# EasyEDA Pro project 3SE_24_Power_Rune.eprj, board Armour (continued)
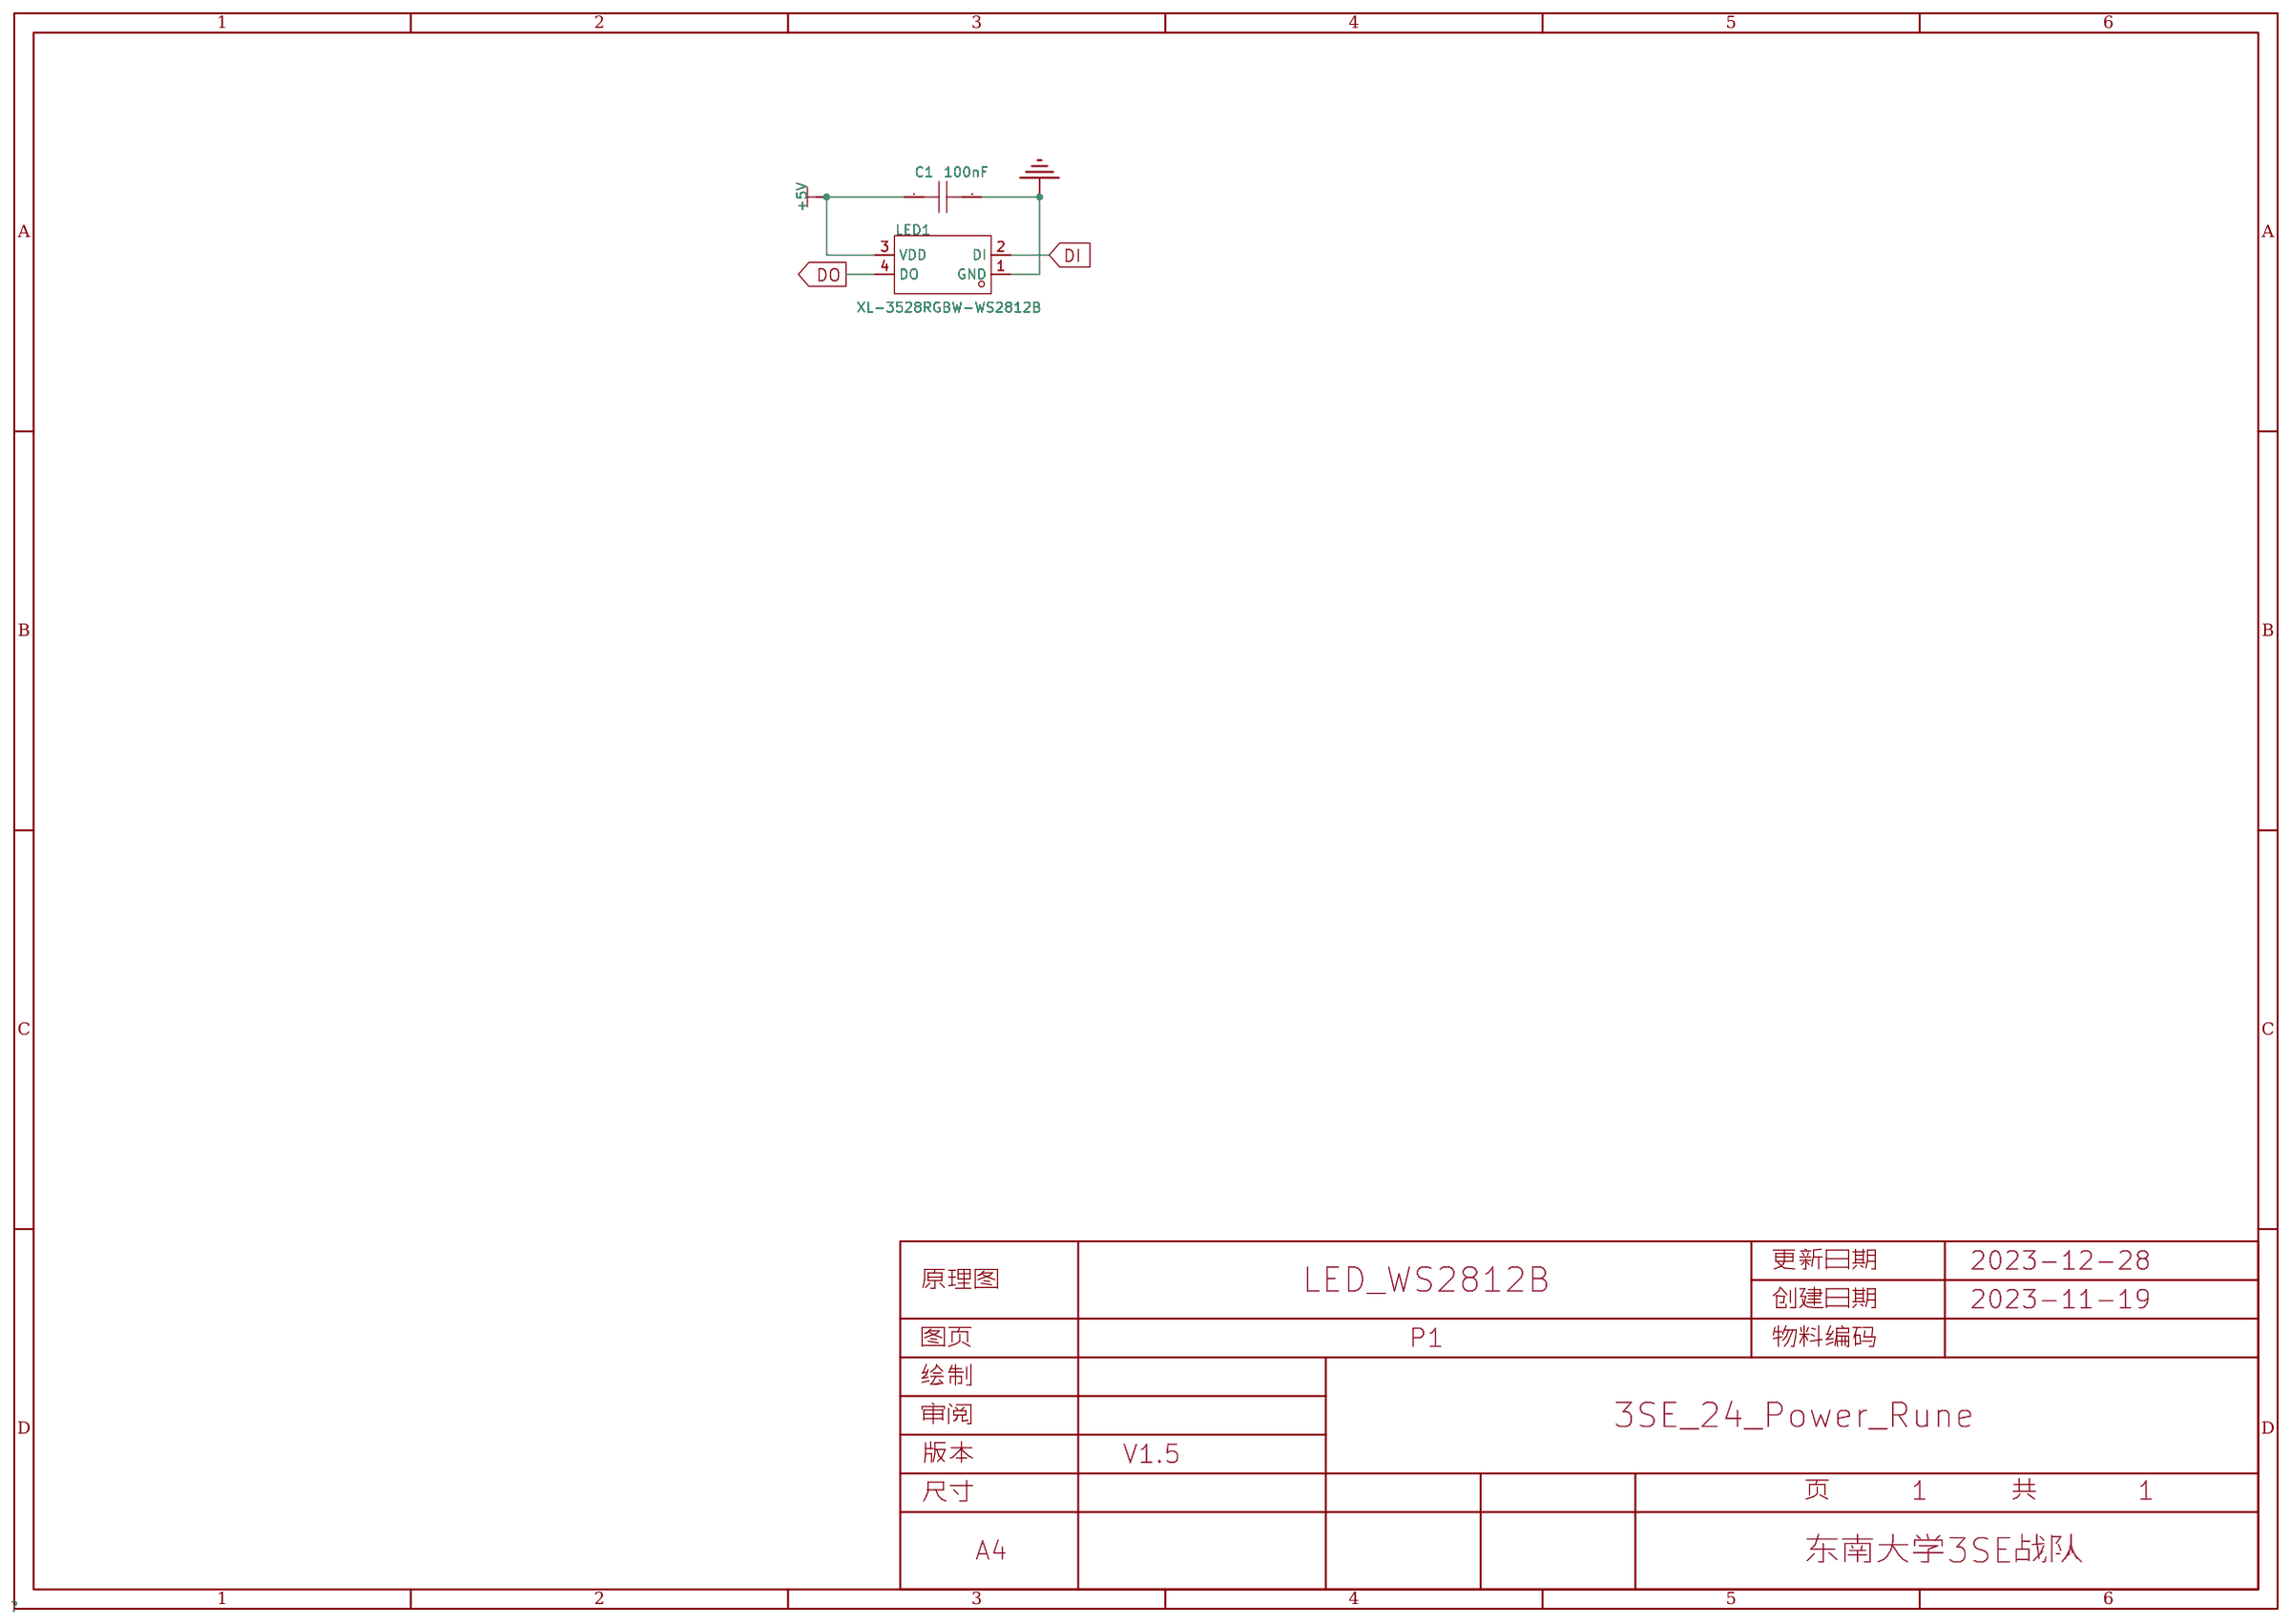
[diagram p0: schematic sheet]
## Routing (per net, layer and track width the routed paths; a pad name or vN(x,y) marks a point on that pad's centre or on a via; arc(x,y) is an arc through that point) (continued)
$12N306: length 22.6
  Top Layer w0.254: LED269.4 318.51,334.47 315.49,334.47 312.38,331.36 307.43,331.36 306.27,332.52 306.27,334.04 307.32,335.09 309.19,335.09
$12N308: length 25.5
  Top Layer w0.254: LED271.2 294.32,339.24 293.64,338.56 293.64,337.33 295.34,335.64 300.22,335.64 302.97,338.38 309.75,338.38 LED270.4
$12N310: length 25.5
  Top Layer w0.254: 299.13,339.79 296.38,342.53 289.6,342.53 286.85,339.79 281.96,339.79 280.27,341.48 280.27,342.71 280.94,343.39 282.45,343.39
$12N312: length 25.3
  Top Layer w0.254: 285.73,343.94 282.98,346.68 276.19,346.68 273.45,343.94 268.94,343.94 266.86,346.01 266.86,346.86 267.54,347.54 269.04,347.54
$12N314: length 25.5
  Top Layer w0.254: LED273.4 269.64,350.83 262.86,350.83 260.11,348.08 255.22,348.08 253.52,349.78 253.52,351.01 254.2,351.69 LED274.2
$12N316: length 25.5
  Top Layer w0.254: LED275.2 240.83,355.83 240.15,355.16 240.15,353.93 241.85,352.23 246.74,352.23 249.48,354.98 256.27,354.98 259.02,352.23
$12N318: length 25.5
  Top Layer w0.254: 245.64,356.38 242.9,359.12 236.11,359.12 233.37,356.38 228.48,356.38 226.78,358.08 226.78,359.31 227.46,359.98 LED276.2
$12N320: length 103.9
  Top Layer w0.254: LED277.2 313.25,338.23 309.23,342.25 299.37,342.25 295.9,345.72 286.98,345.72 281.81,350.89 272.14,350.89 266.86,356.17 250.29,356.17 245.94,360.53 232.27,360.53
$12N322: length 24.8
  Top Layer w0.254: LED277.4 326.82,342.22 321.68,342.22 320.1,340.64 312.65,340.64 311.17,342.12 311.17,343.82 311.99,344.64 LED278.2
$12N702: length 25.5
  Top Layer w0.254: LED279.4 299.35,352.08 292.56,352.08 289.81,349.34 284.93,349.34 283.23,351.03 283.23,352.26 283.91,352.94 LED280.2
$12N704: length 25.5
  Top Layer w0.254: 272.01,357.09 270.5,357.09 269.83,356.42 269.83,355.19 271.52,353.49 276.41,353.49 279.16,356.24 285.94,356.24 288.69,353.49
$12N706: length 25.5
  Top Layer w0.254: LED282.2 257.17,361.24 256.49,360.56 256.49,359.33 258.19,357.63 263.07,357.63 265.82,360.38 272.6,360.38 LED281.4
$12N708: length 25.5
  Top Layer w0.254: LED282.4 259.23,364.53 252.45,364.53 249.7,361.78 244.81,361.78 243.12,363.48 243.12,364.71 243.79,365.38 245.3,365.38
$12N710: length 25.5
  Top Layer w0.254: LED284.2 230.42,369.53 229.75,368.86 229.75,367.63 231.44,365.93 236.33,365.93 239.08,368.68 245.86,368.68 LED283.4
$12N712: length 105.9
  Top Layer w0.254: 235.11,370.09 248.77,370.09 253.12,365.74 269.69,365.74 274.97,360.46 284.64,360.46 289.81,355.29 298.73,355.29 302.2,351.82 312.06,351.82 316.09,347.79 329.79,347.79 331.15,349.16 LED285.2
$12N714: length 28.6
  Top Layer w0.254: LED286.2 313.96,354.2 313.09,353.32 313.09,352.32 315.51,349.9 319.76,349.9 323.1,353.24 330.94,353.24 LED285.4
$12N716: length 25.5
  Top Layer w0.254: LED287.2 300.24,358.34 299.56,357.67 299.56,356.44 301.26,354.74 306.15,354.74 308.9,357.49 315.68,357.49 LED286.4
$12N718: length 25.5
  Top Layer w0.254: LED288.2 286.87,362.49 286.19,361.81 286.19,360.58 287.89,358.89 292.78,358.89 295.52,361.63 302.31,361.63 305.06,358.89
$12N720: length 25.5
  Top Layer w0.254: 261.63,370.79 260.13,370.79 259.45,370.11 259.45,368.88 261.15,367.18 266.03,367.18 268.78,369.93 275.57,369.93 LED289.4
$12N722: length 25.5
  Top Layer w0.254: 248.26,374.94 246.76,374.94 246.08,374.26 246.08,373.03 247.78,371.33 252.66,371.33 255.41,374.08 262.2,374.08 LED290.4
$12N724: length 25.3
  Top Layer w0.254: LED291.4 249.09,377.96 241.78,377.96 239.29,375.48 234.41,375.48 232.71,377.18 232.71,378.41 233.38,379.08 234.89,379.08
$12N726: length 44.7
  Top Layer w0.254: LED293.2 218.22,359.72 218.22,357.67 218.93,356.96 222.84,356.96 226.07,360.19 226.07,376.19 231.91,382.03 235.79,382.03 LED292.4
$12N728: length 26.7
  Top Layer w0.254: LED294.2 203.9,360.88 203.35,360.32 203.35,358.6 204.28,357.67 208.39,357.67 214.69,363.97 220.79,363.97 LED293.4
$12N730: length 26.7
  Top Layer w0.254: 191.36,360.87 189.88,360.87 189.33,360.31 189.33,358.59 190.26,357.66 194.37,357.66 200.67,363.96 206.76,363.96 208.36,362.37
$12N732: length 26.7
  Top Layer w0.254: LED295.4 192.79,363.97 186.69,363.97 180.39,357.67 176.28,357.67 175.35,358.6 175.35,360.32 175.9,360.88 LED296.2
$12N734: length 26.7
  Top Layer w0.254: LED296.4 178.79,363.97 172.69,363.97 166.39,357.67 162.28,357.67 161.35,358.6 161.35,360.32 161.9,360.88 LED297.2
$12N736: length 26.7
  Top Layer w0.254: 149.36,360.87 147.88,360.87 147.33,360.31 147.33,358.59 148.26,357.66 152.37,357.66 158.67,363.96 164.76,363.96 166.36,362.37
$12N978: length 26.7
  Top Layer w0.254: LED300.2 203.9,370.88 203.35,370.32 203.35,368.6 204.28,367.67 208.39,367.67 214.69,373.97 220.79,373.97 LED299.4
$12N980: length 26.7
  Top Layer w0.254: 208.36,372.37 206.76,373.96 200.67,373.96 194.37,367.66 190.26,367.66 189.33,368.59 189.33,370.31 189.88,370.87 191.36,370.87
$12N982: length 26.7
  Top Layer w0.254: LED302.2 175.9,370.88 175.35,370.32 175.35,368.6 176.28,367.67 180.39,367.67 186.69,373.97 192.79,373.97 LED301.4
$12N984: length 26.7
  Top Layer w0.254: LED303.2 161.9,370.88 161.35,370.32 161.35,368.6 162.28,367.67 166.39,367.67 172.69,373.97 178.79,373.97 LED302.4
$12N986: length 26.7
  Top Layer w0.254: 166.36,372.37 164.76,373.96 158.67,373.96 152.37,367.66 148.26,367.66 147.33,368.59 147.33,370.31 147.88,370.87 149.36,370.87
$12N988: length 70.5
  Top Layer w0.254: LED304.4 154.28,372.38 157.98,376.07 214.58,376.07 LED305.2
$12N990: length 26.7
  Top Layer w0.254: 222.36,382.37 220.76,383.96 214.67,383.96 208.37,377.66 204.26,377.66 203.33,378.59 203.33,380.31 203.88,380.87 205.36,380.87
$12N992: length 26.7
  Top Layer w0.254: 191.33,380.86 189.86,380.86 189.3,380.3 189.3,378.58 190.23,377.65 194.34,377.65 200.64,383.95 206.74,383.95 208.33,382.36
$12N994: length 26.7
  Top Layer w0.254: 194.36,382.37 192.76,383.96 186.67,383.96 180.37,377.66 176.26,377.66 175.33,378.59 175.33,380.31 175.88,380.87 177.36,380.87
$12N996: length 26.7
  Top Layer w0.254: 166.33,382.36 164.74,383.95 158.64,383.95 152.34,377.65 148.23,377.65 147.3,378.58 147.3,380.3 147.86,380.86 149.33,380.86
$12N998: length 45.7
  Top Layer w0.254: LED311.2 136.93,356.49 136.93,355.81 138.02,354.72 141.88,354.72 144.28,357.12 144.28,381.39 146.71,383.82 150.94,383.82 LED310.4
$12N1000: length 29.5
  Top Layer w0.254: 125.1,354.2 122.94,352.04 122.94,350.92 123.86,350 128.62,350 133.66,355.04 133.66,358.37 136.4,361.11 140.18,361.11 140.9,360.38 LED311.4
$12N1002: length 29.5
  Top Layer w0.254: 127.59,356.5 127.48,356.5 126.76,357.23 122.98,357.23 120.24,354.49 120.24,351.16 115.2,346.12 110.44,346.12 109.52,347.04 109.52,348.16 111.68,350.32
$12N1004: length 28.6
  Top Layer w0.254: 98.24,346.41 96.08,344.25 96.08,343.14 97,342.22 100.24,342.22 106.8,348.77 106.8,350.59 109.53,353.32 113.31,353.32 114.04,352.6 114.14,352.6
$12N1006: length 29.5
  Top Layer w0.254: 84.79,342.5 82.63,340.35 82.63,339.23 83.56,338.31 88.31,338.31 93.35,343.35 93.35,346.68 96.09,349.42 99.87,349.42 100.6,348.69 100.7,348.69
$12N1008: length 29.5
  Top Layer w0.254: LED315.4 87.13,344.76 86.4,345.48 82.62,345.48 79.88,342.75 79.88,339.42 74.84,334.38 70.08,334.38 69.16,335.3 69.16,336.41 71.32,338.57
$12N1010: length 29.5
  Top Layer w0.254: 57.74,334.62 55.58,332.46 55.58,331.35 56.5,330.43 61.26,330.43 66.3,335.47 66.3,338.8 69.03,341.53 72.81,341.53 73.54,340.81 73.64,340.81
$12N1012: length 25.5
  Top Layer w0.254: LED317.4 60.24,336.94 59.51,337.67 55.54,337.67 53.84,335.96 53.84,329.33 51.01,326.5 47.67,326.5 46.72,327.45 46.72,328.63 47.8,329.71
$12N1254: length 29.5
  Top Layer w0.254: 122.45,363.84 120.29,361.69 120.29,360.57 121.21,359.65 125.97,359.65 131.01,364.69 131.01,368.02 133.75,370.76 137.53,370.76 138.26,370.03 138.36,370.03
$12N1256: length 29.5
  Top Layer w0.254: 124.94,366.15 124.84,366.15 124.11,366.87 120.33,366.87 117.6,364.14 117.6,360.81 112.56,355.77 107.8,355.77 106.88,356.69 106.88,357.8 109.03,359.96
$12N1258: length 29.5
  Top Layer w0.254: 111.5,362.24 111.39,362.24 110.67,362.97 106.89,362.97 104.15,360.23 104.15,356.9 99.11,351.86 94.35,351.86 93.43,352.78 93.43,353.9 95.59,356.06
$12N1260: length 29.5
  Top Layer w0.254: 98.05,358.33 97.95,358.33 97.22,359.06 93.44,359.06 90.71,356.32 90.71,352.99 85.67,347.95 80.91,347.95 79.99,348.87 79.99,349.99 82.15,352.15
$12N1262: length 29.5
  Top Layer w0.254: 68.68,348.22 66.52,346.06 66.52,344.94 67.44,344.02 72.2,344.02 77.24,349.06 77.24,352.39 79.97,355.13 83.75,355.13 84.48,354.4 84.58,354.4
$12N1264: length 29.5
  Top Layer w0.254: 70.99,350.45 70.89,350.45 70.17,351.18 66.39,351.18 63.65,348.44 63.65,345.11 58.61,340.07 53.85,340.07 52.93,340.99 52.93,342.11 55.09,344.27
$12N1266: length 32.2
  Top Layer w0.254: 57.55,346.55 57.45,346.55 56.72,347.27 52.93,347.27 46.04,340.38 46.04,335.54 43.99,333.49 38.81,333.49 37.72,334.58 37.72,335.25 39.31,336.85 39.51,336.85
$12N1268: length 108.6
  Top Layer w0.254: LED327.2 132.96,374.32 126.72,368.08 115.76,368.08 111.94,364.26 101.7,364.26 97.75,360.31 89.45,360.31 85.64,356.5 76.76,356.5 72.64,352.38 63.62,352.38 59.85,348.61 51.45,348.61 LED326.4
$12N1270: length 29.1
  Top Layer w0.254: 135.57,379.63 135.47,379.63 134.74,380.36 131.55,380.36 128.22,377.03 128.22,374.29 123.18,369.25 118.42,369.25 117.5,370.17 117.5,371.29 119.66,373.45
$12N1272: length 29.5
  Top Layer w0.254: 92.8,365.66 90.64,363.5 90.64,362.38 91.56,361.46 96.32,361.46 101.36,366.5 101.36,369.83 104.1,372.57 107.88,372.57 108.6,371.84 108.71,371.84
$12N1274: length 29.5
  Top Layer w0.254: 95.26,367.94 95.16,367.94 94.43,368.66 90.65,368.66 87.92,365.93 87.92,362.6 82.88,357.56 78.12,357.56 77.2,358.48 77.2,359.59 79.36,361.75
$12N1276: length 28.9
  Top Layer w0.254: 81.79,364 81.71,364.08 76.54,364.08 74.45,361.99 74.45,358.66 69.41,353.62 64.65,353.62 63.73,354.54 63.73,355.66 65.89,357.82
$12N1278: length 29.5
  Top Layer w0.254: LED332.4 68.1,360.06 67.38,360.78 63.6,360.78 60.86,358.05 60.86,354.72 55.82,349.68 51.06,349.68 50.14,350.6 50.14,351.71 LED333.2
$12N1280: length 35.8
  Top Layer w0.254: 35.2,348.95 33.58,348.95 32.85,348.22 32.85,345.96 33.9,344.91 38.69,344.91 44.02,350.24 44.02,355.91 44.98,356.88 53.93,356.88 54.66,356.15 LED333.4
$12N1282: length 56.8
  Top Layer w0.254: LED335.2 46.6,317.36 47.31,316.65 48.49,316.65 51.2,319.36 51.2,321.19 48.09,324.3 41.41,324.3 31.07,334.64 31.07,348.92 34.1,351.95 36.94,351.95 37.67,351.23
$12N1284: length 29.8
  Top Layer w0.254: LED335.4 45.44,321.44 42.78,318.78 42.78,313.53 48.75,307.56 48.75,301.37 47.1,299.72 45.1,299.72 LED336.2
$12N1286: length 24.9
  Top Layer w0.254: 41.23,288.78 41.23,288.42 41.88,287.76 44.81,287.76 45.36,288.31 45.36,292.9 40.3,297.96 40.3,302.9 41.5,304.1 43.02,304.1
$12N1288: length 29.6
  Top Layer w0.254: 38.51,274.03 LED338.2 38.44,271.66 39.15,270.95 40.03,270.95 42.64,273.56 42.64,278.15 37.58,283.21 37.58,289.28 40.3,292
$12N1638: length 62.8
  Top Layer w0.254: LED340.2 39.93,316.86 39.93,305.04 36.96,302.06 36.96,289.98 34.22,287.24 34.22,275.15 32.65,273.57 32.65,264.57 LED339.4
$12N1640: length 29.6
  Top Layer w0.254: 34.11,305.35 34.04,305.28 34.04,302.98 34.75,302.27 35.63,302.27 38.24,304.88 38.24,309.47 33.18,314.53 33.18,320.6 35.9,323.32
$12N1642: length 29.6
  Top Layer w0.254: 31.39,290.59 LED342.2 31.32,288.23 32.03,287.52 32.91,287.52 35.52,290.13 35.52,294.72 30.46,299.78 30.46,305.85 33.18,308.57
$12N1644: length 29.6
  Top Layer w0.254: 30.46,293.82 27.74,291.1 27.74,285.03 32.8,279.97 32.8,275.38 30.19,272.77 29.31,272.77 28.6,273.48 LED343.2 28.67,275.84
$12N1646: length 29.6
  Top Layer w0.254: 25.95,261.09 LED344.2 25.88,258.72 26.59,258.01 27.47,258.01 30.08,260.62 30.08,265.21 25.02,270.27 25.02,276.35 27.74,279.06
$12N1648: length 29.6
  Top Layer w0.254: 35.79,259.28 35.72,259.21 35.72,256.91 36.43,256.2 37.31,256.2 39.92,258.81 39.92,263.4 34.86,268.46 34.86,274.53 37.57,277.25
$12N1652: length 33.1
  Top Layer w0.254: 336.73,323.28 338.24,324.79 338.24,327.15 336.85,328.54 322.03,328.54 320.94,327.45 316.65,327.45 315.48,328.62 315.48,330.2 316.59,331.32 LED269.2
$12N1662: length 25.5
  Top Layer w0.254: LED279.2 297.28,348.79 296.6,348.12 296.6,346.89 298.3,345.19 303.19,345.19 305.93,347.94 312.72,347.94 LED278.4
$12N1671: length 25.5
  Top Layer w0.254: 274.97,366.64 273.47,366.64 272.79,365.97 272.79,364.74 274.49,363.04 279.37,363.04 282.12,365.79 288.9,365.79 291.65,363.04
$12N1676: length 70.5
  Top Layer w0.254: LED299.2 214.58,366.07 157.98,366.07 154.28,362.38 LED298.4
$12N1681: length 26.7
  Top Layer w0.254: 163.36,380.87 161.88,380.87 161.33,380.31 161.33,378.59 162.26,377.66 166.37,377.66 172.67,383.96 178.76,383.96 180.36,382.37
$12N1691: length 103.5
  Top Layer w0.254: LED318.4 50.26,334.53 54.74,339 62.64,339 66.41,342.77 75.43,342.77 79.55,346.89 88.43,346.89 92.24,350.7 100.54,350.7 104.49,354.65 114.73,354.65 118.55,358.47 129.51,358.47 135.75,364.72 LED319.2
$12N1696: length 29.5
  Top Layer w0.254: 106.24,369.57 104.09,367.41 104.09,366.29 105.01,365.37 109.77,365.37 114.8,370.41 114.8,373.74 117.54,376.48 121.32,376.48 122.05,375.75 122.15,375.75
$12N3097: length 29.4
  Top Layer w0.254: LED345.4 342.82,146.38 342.82,138.39 346.06,135.15 346.06,131.71 343.99,129.64 342.45,129.64 341.22,130.87 341.22,132.18 LED346.2
$12N3099: length 28.6
  Top Layer w0.254: 341.33,136.02 338.59,133.27 338.59,123.43 340.91,121.11 340.91,117.67 338.84,115.6 337.3,115.6 336.07,116.83 336.07,118.15 336.52,118.61
$12N3101: length 28.6
  Top Layer w0.254: 331.35,104.56 330.89,104.11 330.89,102.79 332.12,101.56 333.66,101.56 335.73,103.63 335.73,107.07 333.41,109.39 333.41,119.23 336.16,121.97
$12N3103: length 28.4
  Top Layer w0.254: 326.11,90.31 325.65,89.86 325.65,88.54 326.88,87.31 328.42,87.31 330.49,89.38 330.49,92.82 328.42,94.89 328.42,105.22 330.92,107.72
$12N3105: length 28.6
  Top Layer w0.254: 320.98,76.41 320.53,75.95 320.53,74.64 321.76,73.41 323.3,73.41 325.37,75.48 325.37,78.92 323.05,81.24 323.05,91.07 325.79,93.82
$12N3107: length 51.5
  Top Layer w0.254: 320.58,79.67 317.8,76.89 317.8,72.53 320.73,69.6 325.54,69.6 332.59,76.65 332.59,88.55 338.49,94.45 341.37,94.45 342.13,95.21 LED351.2
$12N3109: length 33
  Top Layer w0.254: LED351.4 341.8,98.72 342.56,99.48 346.72,99.48 347.59,98.62 347.59,83.7 342.19,78.3 341.35,78.3 LED352.2
$12N3111: length 25.9
  Top Layer w0.254: 338.84,83.8 335.72,80.68 335.72,65.84 334.4,64.52 332.98,64.52 332.21,65.29 332.21,66.5 331.44,67.27
$12N3113: length 25
  Top Layer w0.254: 331.11,70.6 328.78,68.27 328.78,66.45 334.28,60.95 342.84,60.95 344.23,62.34 LED354.2
$12N3115: length 26.9
  Top Layer w0.254: LED356.2 355.82,81.26 354.66,82.43 352.86,82.43 351.7,81.27 351.7,78.42 358.97,71.15 358.97,64.22 357.86,63.11
$12N3117: length 26.9
  Top Layer w0.254: 355.4,96.05 355.4,96.28 354.24,97.44 352.44,97.44 351.28,96.28 351.28,93.43 358.55,86.16 358.55,79.23 357.44,78.12
$12N3119: length 26.9
  Top Layer w0.254: 355,111.04 355,111.27 353.83,112.43 352.03,112.43 350.87,111.27 350.87,108.42 358.14,101.15 358.14,94.23 357.03,93.12
$12N3121: length 26.9
  Top Layer w0.254: LED358.4 357.75,109.19 357.75,116.12 350.48,123.39 350.48,126.24 351.64,127.4 353.44,127.4 354.61,126.24 LED359.2
$12N3123: length 27.9
  Top Layer w0.254: LED360.2 354.2,140.11 354.2,141.23 353.04,142.4 351.24,142.4 350.07,141.24 350.07,136.92 357.35,129.65 357.35,124.19 356.24,123.08
$12N3125: length 121.8
  Top Layer w0.254: LED361.2 336.06,37.22 335.13,36.29 335.13,34.77 335.88,34.02 339.75,34.02 341.22,35.49 341.22,40.02 360.58,59.38 360.58,132.41 355.86,137.13
$12N3127: length 44.1
  Top Layer w0.254: LED361.4 338.96,39.27 338.27,39.96 332.33,39.96 320.56,28.19 307.24,28.19 306,29.43 306,30.96 307.03,31.99 LED362.2
$12N3129: length 27
  Top Layer w0.254: LED362.4 311.43,34.66 305.25,34.66 301.61,31.02 301.61,29.2 298.59,26.18 294.08,26.18 293.27,26.99 293.27,28.42 293.91,29.05 LED363.2
$12N3131: length 27
  Top Layer w0.254: 279.99,26.14 279.22,26.14 278.58,25.5 278.58,24.07 279.39,23.26 283.9,23.26 286.93,26.28 286.93,28.1 290.56,31.74 296.74,31.74 297.35,31.13
$12N3133: length 27
  Top Layer w0.254: 267.93,25.27 267.32,25.88 261.14,25.88 257.5,22.24 257.5,20.42 254.48,17.4 249.97,17.4 249.16,18.21 249.16,19.64 249.8,20.28 250.57,20.28
$12N3135: length 27
  Top Layer w0.254: 253.22,22.33 252.61,22.94 246.43,22.94 242.79,19.31 242.79,17.49 239.77,14.47 235.26,14.47 234.45,15.28 234.45,16.71 235.09,17.34 235.86,17.34
$12N3137: length 27
  Top Layer w0.254: 238.51,19.4 237.9,20.01 231.72,20.01 228.08,16.37 228.08,14.55 225.06,11.53 220.55,11.53 219.74,12.34 219.74,13.77 220.38,14.41 221.15,14.41
$12N3139: length 116
  Top Layer w0.254: 325.17,45.57 325.17,41.24 321.74,37.82 303.17,37.82 299.64,34.29 286.88,34.29 284.08,31.49 271.28,31.49 268.26,28.47 257.01,28.47 254.18,25.64 242.6,25.64 239.35,22.39 229.71,22.39 LED368.4
$12N3141: length 29.2
  Top Layer w0.254: 327.87,47.62 327.76,47.62 327.07,48.31 321.05,48.31 311.56,38.82 306.92,38.82 306.22,39.52 306.22,40.98 307.04,41.79 LED370.2
$12N3143: length 27
  Top Layer w0.254: LED370.4 309.47,44.46 303.29,44.46 299.65,40.82 299.65,39 296.63,35.98 292.12,35.98 291.31,36.79 291.31,38.22 291.95,38.86 LED371.2
$12N3145: length 27
  Top Layer w0.254: 295.4,40.94 294.79,41.55 288.61,41.55 284.97,37.91 284.97,36.09 281.95,33.07 277.44,33.07 276.63,33.88 276.63,35.31 277.27,35.95 278.04,35.95
$12N3147: length 27
  Top Layer w0.254: 280.69,38.01 280.07,38.62 273.9,38.62 270.26,34.98 270.26,33.16 267.24,30.14 262.73,30.14 261.92,30.95 261.92,32.38 262.56,33.02 263.33,33.02
$12N3149: length 27
  Top Layer w0.254: 248.62,30.08 247.85,30.08 247.21,29.44 247.21,28.01 248.02,27.21 252.53,27.21 255.55,30.23 255.55,32.05 259.19,35.69 265.36,35.69 265.98,35.07
$12N3151: length 27
  Top Layer w0.254: 236.55,29.21 235.94,29.82 229.77,29.82 226.13,26.18 226.13,24.36 223.11,21.34 218.6,21.34 217.79,22.15 217.79,23.58 218.43,24.22 219.19,24.22
$12N3153: length 109.9
  Top Layer w0.254: 221.84,26.28 227.78,32.21 237.42,32.21 240.67,35.46 252.25,35.46 255.08,38.29 266.33,38.29 269.35,41.31 282.15,41.31 284.95,44.11 297.71,44.11 300.58,46.99 314.46,46.99 316.76,49.29 316.76,54.44 LED377.2
$12N3155: length 25.3
  Top Layer w0.254: LED377.4 319.52,56.71 318.83,57.4 314.92,57.4 314.19,56.67 314.19,51.3 311.44,48.55 305.22,48.55 304.45,49.32 304.45,50.57 LED378.2
$12N3157: length 27
  Top Layer w0.254: 290.79,48.69 290.02,48.69 289.38,48.05 289.38,46.62 290.19,45.81 294.7,45.81 297.73,48.83 297.73,50.65 301.37,54.29 307.54,54.29 308.15,53.68
$12N3159: length 27
  Top Layer w0.254: 293.47,50.77 292.86,51.38 286.68,51.38 283.04,47.74 283.04,45.92 280.02,42.9 275.51,42.9 274.7,43.71 274.7,45.14 275.34,45.78 276.11,45.78
$12N3161: length 9.9
  Top Layer w0.254: LED381.2 272.31,48.45 278.15,48.45 278.76,47.84
$12N3163: length 28.4
  Top Layer w0.254: 246.69,39.91 245.92,39.91 245.28,39.27 245.28,37.84 246.09,37.03 251.07,37.03 256.53,42.5 265.76,42.5 LED381.4
$12N3165: length 27
  Top Layer w0.254: 249.34,41.97 248.73,42.58 242.55,42.58 238.91,38.94 238.91,37.12 235.89,34.1 231.38,34.1 230.57,34.91 230.57,36.34 231.21,36.98 231.98,36.98
$12N3167: length 27
  Top Layer w0.254: 234.63,39.04 234.01,39.65 227.84,39.65 224.2,36.01 224.2,34.19 221.18,31.17 216.67,31.17 215.86,31.98 215.86,33.41 216.5,34.05 217.27,34.05
$12N3169: length 24.4
  Top Layer w0.254: LED386.2 190.81,12.35 190.81,10.88 191.78,9.91 198.27,9.91 200.25,11.89 200.25,14.9 201.35,16 206.04,16 LED385.4
$12N3171: length 29.3
  Top Layer w0.254: LED387.2 175.81,12.35 175.81,10.88 177.64,9.05 184.4,9.05 185.86,10.51 185.86,15.05 187.61,16.8 192.83,16.8 LED386.4
$12N3173: length 24.6
  Top Layer w0.254: LED388.2 163.23,12.35 163.23,10.88 164.2,9.91 168.25,9.91 170.24,11.89 170.24,14.89 171.35,16 178.63,16 LED387.4
$12N3175: length 42.4
  Top Layer w0.254: LED389.2 204.2,22.54 200.09,18.43 168.44,18.43 167.21,17.2 LED388.4
$12N3177: length 24.4
  Top Layer w0.254: LED389.4 206.04,26 201.35,26 200.25,24.9 200.25,21.89 198.27,19.91 191.78,19.91 190.81,20.88 190.81,22.35 LED390.2
$12N3179: length 27
  Top Layer w0.254: LED390.4 193.63,26 186.35,26 185.25,24.9 185.25,21.89 183.27,19.91 176.78,19.91 175.81,20.88 175.81,22.35 LED391.2
$12N3181: length 24.6
  Top Layer w0.254: LED391.4 178.63,26 171.35,26 170.25,24.9 170.25,21.91 168.25,19.91 164.2,19.91 163.23,20.88 163.23,22.35 LED392.2
$12N3183: length 41
  Top Layer w0.254: 167.14,24.83 169.55,27.24 198.89,27.24 204.2,32.55 LED393.2
$12N3185: length 24.4
  Top Layer w0.254: 207.23,34.84 206.06,36.01 201.37,36.01 200.27,34.91 200.27,31.9 198.29,29.92 191.8,29.92 190.83,30.89 190.83,32.36 191.82,33.34
$12N3187: length 24.5
  Top Layer w0.254: 168.21,29.92 164.22,29.92 163.25,30.89 163.25,32.36 164.24,33.34 ; 170.27,31.98 170.27,34.91 171.37,36.01 178.65,36.01 179.82,34.84 ; 170.27,31.98 170.28,31.99 ; 170.27,31.98 168.21,29.92
$12N3189: length 60.2
  Top Layer w0.254: 145.06,15.5 143.78,15.5 142.77,14.5 142.77,13.02 144.4,11.39 154.4,11.39 156.29,13.28 156.29,38.73 158.76,41.2 162.5,41.2 167.21,36.48 LED396.4
$12N3191: length 26.9
  Top Layer w0.254: 148.31,16.35 145.88,18.78 140.74,18.78 140.03,18.07 140.03,16.41 138.17,14.55 130.49,14.55 129.15,15.89 129.15,17.77 130,18.62 LED398.2
$12N3193: length 26.9
  Top Layer w0.254: LED399.2 115.33,21.73 114.48,20.88 114.48,19 115.82,17.66 123.5,17.66 125.36,19.52 125.36,21.18 126.07,21.89 131.21,21.89 LED398.4
$12N3195: length 26.9
  Top Layer w0.254: 101.05,24.85 100.66,24.85 99.8,24 99.8,22.12 101.14,20.78 108.82,20.78 110.68,22.64 110.68,24.3 111.39,25.01 116.54,25.01 LED399.4
$12N3197: length 26.9
  Top Layer w0.254: LED400.4 101.86,28.12 96.72,28.12 96.01,27.41 96.01,25.75 94.15,23.89 86.47,23.89 85.13,25.23 85.13,27.11 85.98,27.97 LED401.2
$12N3199: length 26.9
  Top Layer w0.254: LED401.4 87.19,31.24 82.05,31.24 81.34,30.53 81.34,28.87 79.48,27.01 71.8,27.01 70.46,28.35 70.46,30.23 71.31,31.08 71.7,31.08
$12N3201: length 26.9
  Top Layer w0.254: 75.04,31.89 72.61,34.32 67.47,34.32 66.76,33.61 66.76,31.95 64.9,30.09 57.22,30.09 55.88,31.43 55.88,33.31 56.73,34.16 57.12,34.16
$12N3203: length 35
  Top Layer w0.254: LED403.4 58.67,36.65 31.17,36.65 29.89,37.93 29.89,39.14 30.89,40.14 31.69,40.14 31.71,40.15
$12N3205: length 26.9
  Top Layer w0.254: LED406.2 132.08,28.4 131.23,27.55 131.23,25.67 132.57,24.33 140.25,24.33 142.11,26.19 142.11,27.85 142.82,28.56 147.96,28.56 LED405.4
$12N3207: length 26.9
  Top Layer w0.254: LED406.4 133.29,31.67 128.14,31.67 127.43,30.96 127.43,29.3 125.57,27.44 117.89,27.44 116.55,28.78 116.55,30.66 117.41,31.52 117.8,31.52
$12N3209: length 26.9
  Top Layer w0.254: LED408.2 102.73,34.63 101.88,33.78 101.88,31.9 103.22,30.56 110.9,30.56 112.76,32.42 112.76,34.08 113.47,34.79 118.61,34.79 LED407.4
$12N3211: length 26.9
  Top Layer w0.254: 106.37,35.48 103.94,37.9 98.8,37.9 98.09,37.19 98.09,35.53 96.23,33.67 88.55,33.67 87.21,35.01 87.21,36.89 88.06,37.75 LED409.2
$12N3213: length 25.9
  Top Layer w0.254: LED410.2 73.39,40.86 72.54,40.01 72.54,38.13 73.88,36.79 81.19,36.79 85.42,41.02 88.89,41.02 91.32,38.59 91.7,38.59
$12N3215: length 26.9
  Top Layer w0.254: 77.12,41.67 74.69,44.1 69.55,44.1 68.84,43.39 68.84,41.73 66.98,39.87 59.3,39.87 57.96,41.21 57.96,43.09 58.81,43.95 59.2,43.95
$12N3217: length 29.8
  Top Layer w0.254: LED412.2 40,48.25 39.11,48.25 38.5,47.64 38.5,45.69 39.44,44.75 44.23,44.75 46.08,46.6 60.58,46.6 62.35,44.82
$12N3219: length 115.5
  Top Layer w0.254: LED412.4 45.48,50.78 55.48,50.78 58.35,47.92 71.48,47.92 74.33,45.07 86.41,45.07 90.1,41.37 101.66,41.37 105.68,37.36 115.79,37.36 117.25,35.9 130.9,35.9 134.7,32.1 146.25,32.1 LED413.2
$12N3221: length 26.9
  Top Layer w0.254: LED413.4 150.04,38.34 144.89,38.34 144.18,37.63 144.18,35.97 142.32,34.11 134.64,34.11 133.3,35.45 133.3,37.33 134.16,38.18 LED414.2
$12N3223: length 30.6
  Top Layer w0.254: LED415.4 120.69,44.57 115.55,44.57 114.84,43.86 114.84,42.36 113.52,41.04 103.51,41.04 101.61,42.94 100.14,42.94 99.7,43.38 99.7,44.53 100.84,45.66 100.84,45.75
$12N3227: length 26.9
  Top Layer w0.254: LED418.2 75.47,50.65 74.61,49.79 74.61,47.91 75.95,46.57 83.63,46.57 85.49,48.43 85.49,50.09 86.2,50.8 91.35,50.8 93.77,48.37
$12N3229: length 26.9
  Top Layer w0.254: 79.19,51.46 76.77,53.88 71.62,53.88 70.91,53.17 70.91,51.51 69.05,49.65 61.37,49.65 60.03,50.99 60.03,52.87 60.89,53.73 61.28,53.73
$12N3231: length 26.9
  Top Layer w0.254: LED419.4 62.11,56.93 55.63,56.93 52.13,53.43 45.6,53.43 44.43,54.6 44.43,56.27 45.04,56.88 LED420.2
$12N3233: length 53.2
  Top Layer w0.254: LED421.2 13.97,69.37 12.7,69.37 11.67,68.34 11.67,62.57 13.85,60.39 29.57,60.39 33.18,64 43.48,64 LED420.4
$12N3235: length 25.3
  Top Layer w0.254: LED422.2 14.89,84.12 13.29,84.12 12.43,83.26 12.43,77.29 18.16,71.56 18.16,66.79 LED421.4
$12N3237: length 25.3
  Top Layer w0.254: 16.52,98.14 15.58,99.07 13.98,99.07 13.12,98.21 13.12,92.24 18.85,86.51 18.85,81.75 17.2,80.09
$12N3239: length 25.3
  Top Layer w0.254: 17.2,113.12 16.27,114.06 14.67,114.06 13.81,113.2 13.81,107.23 19.54,101.5 19.54,96.73 17.88,95.07
$12N3241: length 25.3
  Top Layer w0.254: 19.25,125.04 20.91,126.7 20.91,131.47 15.18,137.2 15.18,143.17 16.04,144.03 17.64,144.03 18.57,143.09
$12N3243: length 75.9
  Top Layer w0.254: LED426.4 23.48,136.5 23.48,69.98 LED427.2
$12N3245: length 12.7
  Top Layer w0.254: LED428.2 35.47,68.85 30.45,63.83 27.86,63.83
$12N3247: length 32.5
  Top Layer w0.254: 40.78,66.42 42.54,68.18 42.54,74.37 39.22,77.69 28.5,77.69 26.35,79.84 26.35,81.46 27.71,82.82 LED429.2
$12N3249: length 21
  Top Layer w0.254: LED430.2 26.84,95.7 26.04,94.9 26.04,92.05 32.76,85.33 32.76,81.29 LED429.4
$12N3253: length 16.2
  Top Layer w0.254: LED355.2 352.63,69.64 345.45,69.64 LED354.4
$12N3257: length 27
  Top Layer w0.254: 282.64,28.2 282.03,28.81 275.85,28.81 272.21,25.17 272.21,23.35 269.19,20.33 264.68,20.33 263.87,21.14 263.87,22.57 264.51,23.21 265.28,23.21
$12N3261: length 27
  Top Layer w0.254: 251.26,32.14 250.65,32.75 244.48,32.75 240.84,29.11 240.84,27.29 237.82,24.27 233.31,24.27 232.5,25.08 232.5,26.51 233.14,27.15 233.91,27.15
$12N3265: length 45.6
  Top Layer w0.254: LED384.4 219.75,36.06 219.06,36.75 216.17,36.75 213.48,34.06 213.48,12.1 211.34,9.96 203.54,9.96 202.28,11.22 202.28,12.01 203.6,13.33 LED385.2
$12N3269: length 30.6
  Top Layer w0.254: 194.82,34.84 190.98,38.68 184.9,38.68 182.56,36.34 182.56,30.9 181.58,29.92 176.8,29.92 175.83,30.89 175.83,32.36 176.82,33.34
$12N3273: length 121.2
  Top Layer w0.254: LED404.4 53.41,41 56.27,38.14 70.42,38.14 73.27,35.29 83.45,35.29 86.28,32.46 97.53,32.46 100.44,29.55 111.74,29.55 114.96,26.33 128.37,26.33 132.38,22.32 144.17,22.32 LED405.2
$12N3277: length 26.9
  Top Layer w0.254: 119.87,41.3 119.48,41.3 118.63,40.45 118.63,38.56 119.97,37.23 127.65,37.23 129.51,39.09 129.51,40.75 130.22,41.46 135.36,41.46 LED414.4
$12N3291: length 25.3
  Top Layer w0.254: 18.57,110.06 20.22,111.72 20.22,116.48 14.49,122.21 14.49,128.18 15.35,129.04 16.95,129.04 17.89,128.11
$12N3294: length 23.3
  Top Layer w0.254: 104.08,46.6 104.08,46.84 101.87,49.06 99.98,49.06 98.59,47.66 98.59,46 96.05,43.46 90.63,43.46 89.29,44.8 89.29,46.68 90.14,47.53 LED417.2
$12N6150: length 26.5
  Top Layer w0.254: 44.64,93.18 42.51,93.18 41.49,92.16 41.49,90.42 43.38,88.53 46.49,88.53 53.42,81.6 53.42,78.16 LED432.4
$12N6151: length 26.5
  Top Layer w0.254: LED433.4 48.56,92.35 48.56,95.79 41.63,102.72 38.52,102.72 36.63,104.61 36.63,106.35 37.65,107.37 LED434.2
$12N6152: length 24
  Top Layer w0.254: LED432.2 45.7,78.98 LED430.4
$12N6190: length 26.5
  Top Layer w0.254: 30.1,135.72 27.97,135.72 26.95,134.7 26.95,132.96 28.84,131.07 31.95,131.07 38.88,124.14 38.88,120.71 37.34,119.18
$12N6191: length 26.5
  Top Layer w0.254: 25.24,149.92 23.11,149.92 22.09,148.9 22.09,147.16 23.82,145.43 26.93,145.43 34.02,138.34 34.02,134.9 32.49,133.37
$12N6192: length 25.5
  Top Layer w0.254: 34.88,121.7 32.75,121.7 31.73,120.68 31.73,118.94 33.62,117.05 36.73,117.05 42.49,111.29 42.49,105.52 42.13,105.16

## Copper pours and planes (outline as drawn; the poured copper is in the pictures)
+3V3 on Top Layer: 329.98,211.35 338.95,211.35 338.95,203.31 329.98,203.31
+3V3 on Bottom Layer: 326.67,234.76 343.48,234.76 343.48,193.67 326.67,193.67
+5V on Top Layer: 329.09,204.59 333.27,204.59 333.27,201.24 329.09,201.24
+5V on Top Layer: 18.8,196.56 39.48,196.56 39.48,171.19 18.8,171.19
+5V on Bottom Layer: 145.24,353.42 114.06,343.81 61.2,329.25 39.24,249.17 25.16,249.33 18.55,259.49 31.63,356.77 135.27,386.99 235.21,386.61 287.79,370.99 339.23,355.12 343.8,319.05 348.37,291.87 352.94,257.33 343.67,248.06 330.56,248.06 310.4,327.68 268.11,340.51 226.25,353.42
+5V on Bottom Layer: 341.42,211.53 347.94,211.53 347.94,205.05 341.42,205.05
+5V on Bottom Layer: outline of 400 points within 25.75,36.24 345.74,356.23
+5V on Bottom Layer: 348.34,253.75 349.61,252.48 349.61,250.49 346.1,250.49 345.33,251.26 345.33,253.21 345.86,253.75
+5V on Bottom Layer: 167.66,45.36 67.83,63.21 32.19,157.82 11.44,152.77 10.42,135.25 5.34,43.05 84.46,25.14 168.13,6.8 201.51,6.8 328.17,32.88 365.64,41.39 362.72,109.47 360.56,153.79 352.81,155.95 340.59,159.49 305.86,63.61 260.86,55.36 205.22,45.07
+24V on Top Layer: 18.83,241.94 37.25,241.94 37.25,219.42 18.83,219.42
GND on Top Layer: 151.32,355.12 114.62,343.81 61.15,329.08 43.55,264.92 37.23,245.04 26.82,245.15 18.84,257.43 32.19,356.77 135.83,386.99 235.77,386.61 288.35,370.99 339.79,355.12 344.36,319.05 348.93,291.87 353.5,257.33 344.23,248.06 334.79,248.06 318.58,297.59 310.96,327.68 268.67,340.51 221.3,355.12
GND on Top Layer: -6.96,422.39 376.88,422.39 376.88,-34.62 -6.96,-34.62
GND on Top Layer: 163.54,42.58 65.82,60.05 52.49,95.74 30.52,153.78 11.72,149.21 10.71,131.68 5.63,39.48 84.75,21.57 167.09,3.52 203.2,3.52 328.46,29.32 365.93,37.83 363,105.9 360.85,150.22 353.1,152.38 343.45,155.18 327.32,113.01 308.27,60.44 261.15,51.8 209.43,42.23
GND on Bottom Layer: 336.2,230.47 343.08,230.47 343.08,224.18 336.2,224.18
GND on Bottom Layer: 351.76,226.18 353.64,226.18 353.64,248.31 352.64,248.31 352.64,227.85 351.76,226.97
$11N31259 on Top Layer: 18.51,224.94 34.61,224.94 34.61,180.04 18.51,180.04

Small or netless copper shapes (teardrops, artwork), in the pictures only: 3285 on Top Layer, 376 on Bottom Layer

## Text on the board
Top Silkscreen Layer: + - / | - D4 | + - D3 | RST | BOOT | LED_EN | -  + | - + | R T - + | 24V@2A | 灯臂灯条 | 流水灯矩阵 | 2023.12.29 Ver 1.5, By CH | D0 主灯环 | D1 上灯带 | D2 下灯带 | 大能量机关装甲板
